# EasyEDA Pro project 3SE_24_Power_Rune.eprj, schematic Armour (continued)
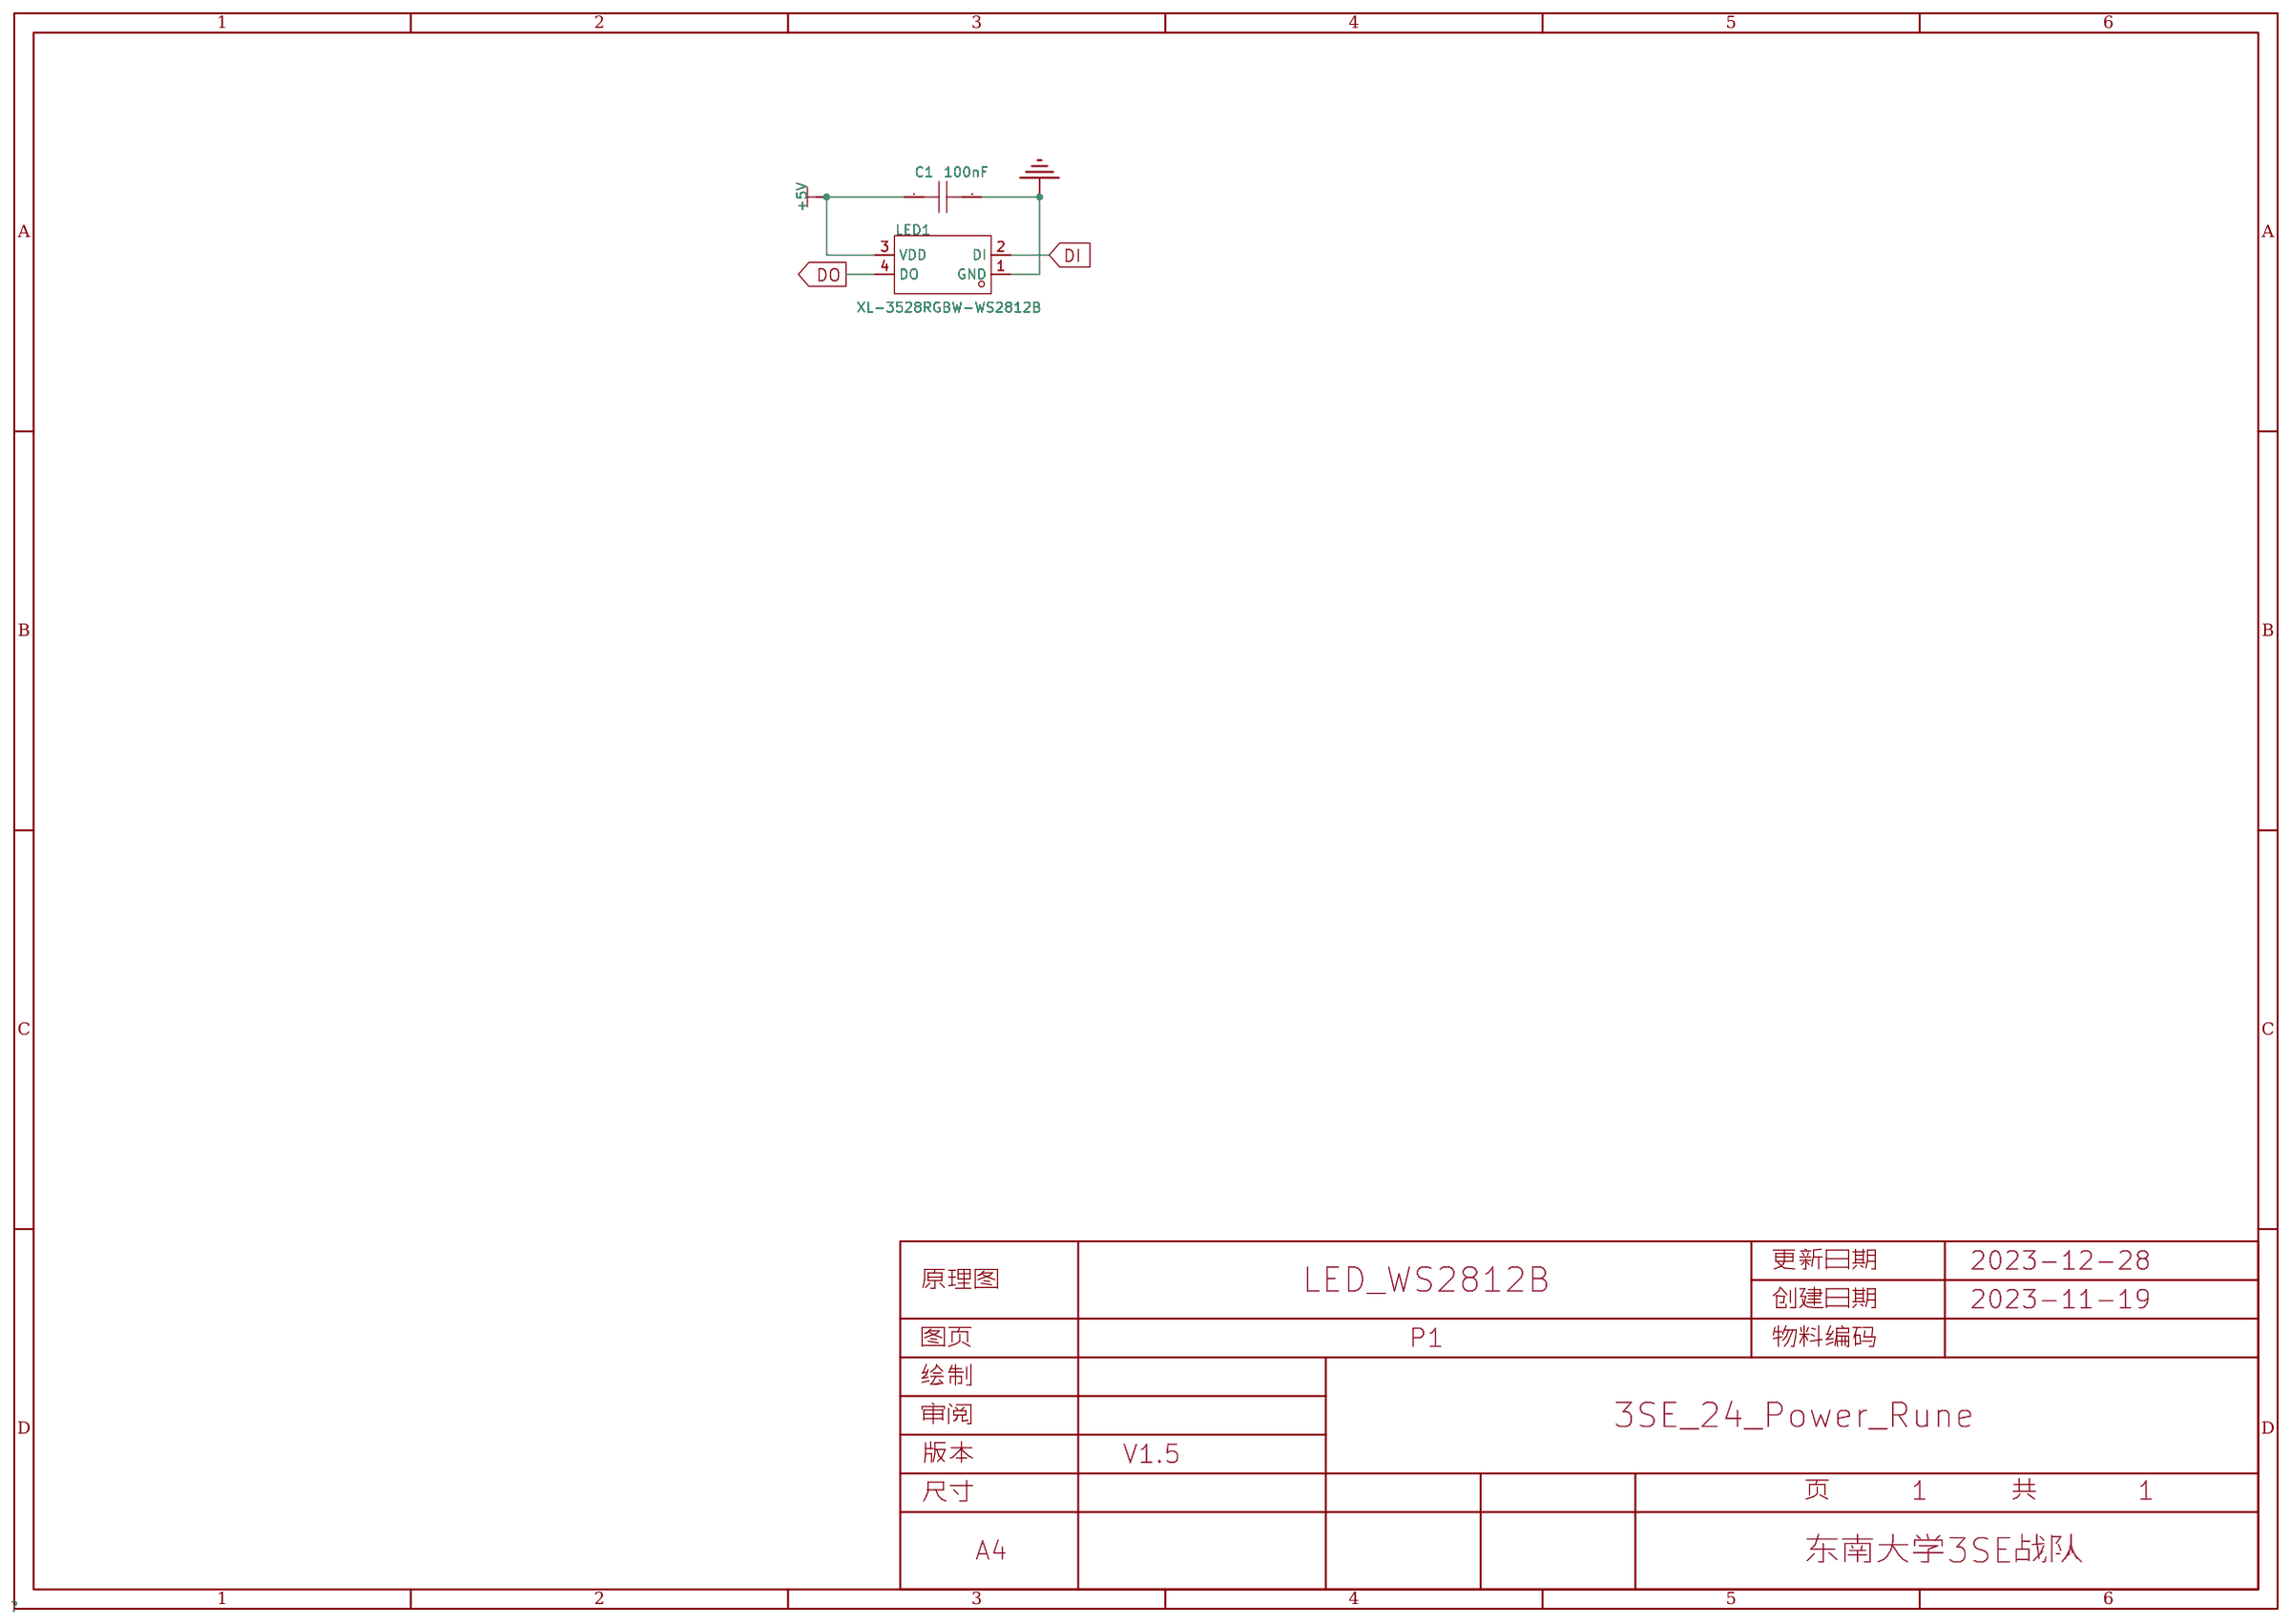
[diagram p0: schematic sheet]
## Library data of the parts (continued)
SW3 = DSHP01TSGER: 电路结构:单刀单掷;开关位数:1位;额定电流:25mA;额定电压:24V;使用寿命:3千次;颜色:黑色;; LCSC Part Name: 1位单PIN 1.27mm间距贴片型 KE拨码开关 编码开关; Supplier Part: C3293141; Manufacturer: 康深; Supplier Footprint: SMD,2.9x5.4mm; JLCPCB Part Class: 扩展库; Datasheet: https://atta.szlcsc.com/upload/public/pdf/source/20220713/BDDC0447A52B6A23E8804DA200FD4C7C.pdf; Supplier: LCSC; Circuit: 单刀单掷; Number of Positions: 1位; Current Rating: 25mA; Voltage Rating: 24V; Operating Temperature: -30℃~+85℃; Operating Life: 3千次; Color: 黑色
U1 = XL4016E1: 功能类型:降压型;输入电压:8V~40V;输出电压:1.25V~36V;输出电流(最大值):8A;; Supplier Part: C55881; Manufacturer: XLSEMI(芯龙); Supplier Footprint: TO-220-5; JLCPCB Part Class: 扩展库; Datasheet: https://atta.szlcsc.com/upload/public/pdf/source/20221017/BA256A5392B705775B4C335FAFB3EDCF.pdf; Supplier: LCSC; Function: 降压型; Synchronous Rectification: 否; Number of Outputs: 1; Topology: 降压式; Input Voltage: 8V~40V; Output Voltage: 1.25V~36V; Output Current (Max): 8A; Switching Frequency: 180kHz
U2 = AMS1117-3.3_C347222: 输出类型:固定;最大输入电压:18V;输出电压:3.3V;输出电流:1A;电源纹波抑制比(PSRR):60dB@(120Hz);输出极性:正;; LCSC Part Name: 输入18V 输出3.3V 1A; Supplier Part: C347222; Manufacturer: UMW(友台半导体); Supplier Footprint: SOT-223; JLCPCB Part Class: Extended Part; Datasheet: https://atta.szlcsc.com/upload/public/pdf/source/20231109/155D79A26D9DB04352555A58D5969DC8.pdf; Supplier: LCSC; Output Type: 固定; Output Polarity: 正; Number of Outputs: 1; Maximum Input Voltage: 18V; Output Voltage: 3.3V; Dropout Voltage: 1.3V@(1A); Output Current: 1A; Power Supply Rejection Ratio (PSRR): 60dB@(120Hz)
U3 = ESP32-S3-WROOM-1-N8R2: Supplier Part: C2913204; Manufacturer: ESPRESSIF(乐鑫); Supplier Footprint: SMD,18x25.5mm; JLCPCB Part Class: 扩展库; Datasheet: https://atta.szlcsc.com/upload/public/pdf/source/20220628/A2AC12B3C87735CAEB7EBE2DBE80936C.pdf; Supplier: LCSC
U4 = 74HC4051D,653: Supplier Part: C9386; Manufacturer: Nexperia(安世); Supplier Footprint: SOIC-16; JLCPCB Part Class: 扩展库; Datasheet: https://atta.szlcsc.com/upload/public/pdf/source/20211209/7A90BCDB54D2694B8637C473CF20976E.pdf; Supplier: LCSC
USB1 = TYPE-C 16PIN 2MD(073): 连接器类型:Type-C;标准:-;公母:母座;触点数量:16;端口数量:1;安装方式:卧贴;额定电流 - 电源:5A;工作温度范围:-25℃~+85℃;; LCSC Part Name: TYPE-C母座 16P 4脚插件带定位柱 不锈钢外壳 2次模顶; Supplier Part: C2765186; Manufacturer: SHOU HAN(首韩); Supplier Footprint: SMD; JLCPCB Part Class: 扩展库; Supplier: LCSC; Connector Type: Type-C; Gender: 母座; Number of Contacts: 16; Number of Ports: 1; Mounting Style: 卧贴; Current Rating - Power (Max): 5A; Operating Temperature Range: -25℃~+85℃
X1 = Q13FC1350000400: 频率:32.768kHz;频率公差:±20ppm;负载电容:12.5pF;; LCSC Part Name: 32.768kHz ±20ppm 12.5pF; Supplier Part: C32346; Manufacturer: EPSON(爱普生); Supplier Footprint: SMD3215-2P; JLCPCB Part Class: Basic Part; Datasheet: https://atta.szlcsc.com/upload/public/pdf/source/20190108/C32346_746D6B07EAF90824457A96480007685F.pdf; Supplier: LCSC; Crystal Type: 贴片无源晶振; Frequency Tolerance: ±20ppm; Load Capacitance: 12.5pF; Equivalent Series Resistance (ESR): 70kΩ; Operating Temperature: -40℃~+85℃
KEY1-KEY51 = 热插拔轴座: Check: false

## Nets
+3V3: 3V3.1 C434.1 C435.2 C445.1 C446.1 C448.1 R2.2 R3.2 R5.2 R8.2 R11.2 R12.2 R14.2 R17.2 R18.1 R25.2 R26.2 R28.1 R30.2 R31.1 U2.2(VOUT(TAB)) U2.4(TAB) U3.2(3V3) U4.16(VCC)
+5V: 5V.1 C436.1 C437.2 C438.2 C439.1 C440.2 CN2.1 CN3.1 CN5.1 CN6.4 D3.2(A) D4.5 L1.2 R1.2 U2.3(VIN) USB1.2(VBUS) USB1.11(VBUS)
+24V: 24V.1 C431.2 C432.1 C433.2 CN1.2 D1.2 U1.5(VIN)
GND: C431.1 C432.2 C434.2 C435.1 C436.2 C437.1 C439.2 C440.1 C441.1 C442.1 C443.1 C444.1 C445.2 C446.2 C447.1 C448.2 C449.1 C450.2 C451.1 C452.2 C453.1 C454.2 C456.1 C457.1 CN1.1 CN1.3 CN1.4 CN2.2 CN2.4 CN2.5 CN3.2 CN3.4 CN3.5 CN4.1 CN4.3 CN4.4 CN5.2 CN5.3 CN5.4 CN6.3 CN6.5 CN6.6 D1.1 D2.1(A) D2.3(A) D3.1(K) D4.2 KEY1.1(Pin1) KEY2.1(Pin1) KEY3.1(Pin1) KEY4.1(Pin1) KEY5.1(Pin1) KEY6.1(Pin1) KEY7.1(Pin1) KEY8.1(Pin1) KEY9.1(Pin1) KEY10.1(Pin1) KEY11.1(Pin1) KEY12.1(Pin1) KEY13.1(Pin1) KEY14.1(Pin1) KEY15.1(Pin1) KEY16.1(Pin1) KEY17.1(Pin1) KEY18.1(Pin1) KEY19.1(Pin1) KEY20.1(Pin1) KEY21.1(Pin1) KEY22.1(Pin1) KEY23.1(Pin1) KEY24.1(Pin1) KEY25.1(Pin1) KEY26.1(Pin1) KEY27.1(Pin1) KEY28.1(Pin1) KEY29.1(Pin1) KEY30.1(Pin1) KEY31.1(Pin1) KEY32.1(Pin1) KEY33.1(Pin1) KEY34.1(Pin1) KEY35.1(Pin1) KEY36.1(Pin1) KEY37.1(Pin1) KEY38.1(Pin1) KEY39.1(Pin1) KEY40.1(Pin1) KEY41.1(Pin1) KEY42.1(Pin1) KEY43.1(Pin1) KEY44.1(Pin1) KEY45.1(Pin1) KEY46.1(Pin1) KEY47.1(Pin1) KEY48.1(Pin1) KEY49.1(Pin1) KEY50.1(Pin1) KEY51.1(Pin1) R6.1 R15.1 R20.1 R22.1 R23.1 R24.1 R32.1 R33.1 SW1.2 SW2.2 U1.1(GND) U2.1(ADJ(GND)) U3.1(GND) U3.40(GND) U3.41(GND) U4.7(VEE) U4.8(GND) USB1.1(GND) USB1.12(GND) USB1.13(SHELL) USB1.14(SHELL)
BOOT: SW2.1 U3.27(IO0)
DIN: U3.19(IO11) U4.3(Z)
DIN0: CBB1.1(DI) R23.2 U4.13(Y0)
DIN1: CBB259.1(DI) R22.2 U4.14(Y1)
DIN2: CBB345.1(DI) R20.2 U4.15(Y2)
DIN3: CN2.3 R24.2 U4.12(Y3)
DIN4: CN4.2 R15.2 U4.1(Y4)
DN: D4.6 U3.13(IO19)
DP: D4.4 U3.14(IO20)
KEY1: KEY44.2(Pin2) KEY45.2(Pin2) KEY46.2(Pin2) KEY47.2(Pin2) KEY48.2(Pin2) KEY49.2(Pin2) KEY50.2(Pin2) KEY51.2(Pin2) R4.1
KEY1_IN: C441.2 R2.1 R4.2 U3.39(IO1)
KEY2: KEY36.2(Pin2) KEY37.2(Pin2) KEY38.2(Pin2) KEY39.2(Pin2) KEY40.2(Pin2) KEY41.2(Pin2) KEY42.2(Pin2) KEY43.2(Pin2) R7.1
KEY2_IN: C442.2 R3.1 R7.2 U3.38(IO2)
KEY3: KEY28.2(Pin2) KEY29.2(Pin2) KEY30.2(Pin2) KEY31.2(Pin2) KEY32.2(Pin2) KEY33.2(Pin2) KEY34.2(Pin2) KEY35.2(Pin2) R9.1
KEY3_IN: C443.2 R5.1 R9.2 U3.4(IO4)
KEY4: KEY20.2(Pin2) KEY21.2(Pin2) KEY22.2(Pin2) KEY23.2(Pin2) KEY24.2(Pin2) KEY25.2(Pin2) KEY26.2(Pin2) KEY27.2(Pin2) R10.1
KEY4_IN: C444.2 R8.1 R10.2 U3.5(IO5)
KEY5: KEY16.2(Pin2) KEY17.2(Pin2) KEY18.2(Pin2) KEY19.2(Pin2) R13.1
KEY5_IN: C447.2 R11.1 R13.2 U3.6(IO6)
KEY6: KEY12.2(Pin2) KEY13.2(Pin2) KEY14.2(Pin2) KEY15.2(Pin2) R16.1
KEY6_IN: C449.2 R12.1 R16.2 U3.7(IO7)
KEY7: KEY8.2(Pin2) KEY9.2(Pin2) KEY10.2(Pin2) KEY11.2(Pin2) R19.1
KEY7_IN: C451.2 R14.1 R19.2 U3.18(IO10)
KEY8: KEY4.2(Pin2) KEY5.2(Pin2) KEY6.2(Pin2) KEY7.2(Pin2) R21.1
KEY8_IN: C453.2 R17.1 R21.2 U3.20(IO12)
KEY9: KEY2.2(Pin2) KEY3.2(Pin2) R27.1
KEY9_IN: C456.2 R25.1 R27.2 U3.12(IO8)
KEY10: KEY1.2(Pin2) R29.1
KEY10_IN: C457.2 R26.1 R29.2 U3.17(IO9)
RST: C450.1 R18.2 SW1.1 U3.3(EN)
RX: CN6.1 U3.36(RXD0)
TX: CN6.2 U3.37(TXD0)
~CS0: U3.22(IO14) U4.11(S0)
~CS1: U3.23(IO21) U4.10(S1)
~CS2: U3.31(IO38) U4.9(S2)
~EN_DEMUX: R31.2 SW3.1 U4.6(E)
$11N923: R28.2 U3.15(IO3)
$11N2441: C438.1 R1.1 R6.2 U1.2(FB)
$11N5632: C452.1 U3.8(IO15) X1.1
$11N5639: C454.1 U3.9(IO16) X1.2
$11N5674: SW3.2 U3.21(IO13)
$11N5844: LED431.2(A) R30.1
$11N5848: LED431.1(K) U3.25(IO48)
$11N11553: R32.2 USB1.4(CC1)
$11N11554: R33.2 USB1.10(CC2)
$11N31259: D2.2(K) L1.1 U1.3(SW)
$11N48563: C433.1 U1.4(VC)
$11N53990: D4.3 USB1.6(DP1) USB1.8(DP2)
$11N54016: D4.1 USB1.5(DN2) USB1.7(DN1)
Net-(CBB1-2): CBB1.2(DO) CBB2.1(DI)
Net-(CBB2-2): CBB2.2(DO) CBB3.1(DI)
Net-(CBB3-2): CBB3.2(DO) CBB4.1(DI)
Net-(CBB4-2): CBB4.2(DO) CBB5.1(DI)
Net-(CBB5-2): CBB5.2(DO) CBB6.1(DI)
Net-(CBB6-2): CBB6.2(DO) CBB7.1(DI)
Net-(CBB7-2): CBB7.2(DO) CBB8.1(DI)
Net-(CBB8-2): CBB8.2(DO) CBB9.1(DI)
Net-(CBB9-2): CBB9.2(DO) CBB10.1(DI)
Net-(CBB10-2): CBB10.2(DO) CBB11.1(DI)
Net-(CBB11-2): CBB11.2(DO) CBB12.1(DI)
Net-(CBB12-2): CBB12.2(DO) CBB13.1(DI)
Net-(CBB13-2): CBB13.2(DO) CBB14.1(DI)
Net-(CBB14-2): CBB14.2(DO) CBB15.1(DI)
Net-(CBB15-2): CBB15.2(DO) CBB16.1(DI)
Net-(CBB16-2): CBB16.2(DO) CBB17.1(DI)
Net-(CBB17-2): CBB17.2(DO) CBB18.1(DI)
Net-(CBB18-2): CBB18.2(DO) CBB19.1(DI)
Net-(CBB19-2): CBB19.2(DO) CBB20.1(DI)
Net-(CBB20-2): CBB20.2(DO) CBB21.1(DI)
Net-(CBB21-2): CBB21.2(DO) CBB22.1(DI)
Net-(CBB22-2): CBB22.2(DO) CBB23.1(DI)
Net-(CBB23-2): CBB23.2(DO) CBB24.1(DI)
Net-(CBB24-2): CBB24.2(DO) CBB25.1(DI)
Net-(CBB25-2): CBB25.2(DO) CBB26.1(DI)
Net-(CBB26-2): CBB26.2(DO) CBB27.1(DI)
Net-(CBB27-2): CBB27.2(DO) CBB28.1(DI)
Net-(CBB28-2): CBB28.2(DO) CBB29.1(DI)
Net-(CBB29-2): CBB29.2(DO) CBB30.1(DI)
Net-(CBB30-2): CBB30.2(DO) CBB31.1(DI)
Net-(CBB31-2): CBB31.2(DO) CBB32.1(DI)
Net-(CBB32-2): CBB32.2(DO) CBB33.1(DI)
Net-(CBB33-2): CBB33.2(DO) CBB34.1(DI)
Net-(CBB34-2): CBB34.2(DO) CBB35.1(DI)
Net-(CBB35-2): CBB35.2(DO) CBB36.1(DI)
Net-(CBB36-2): CBB36.2(DO) CBB37.1(DI)
Net-(CBB37-2): CBB37.2(DO) CBB38.1(DI)
Net-(CBB38-2): CBB38.2(DO) CBB39.1(DI)
Net-(CBB39-2): CBB39.2(DO) CBB40.1(DI)
Net-(CBB40-2): CBB40.2(DO) CBB41.1(DI)
Net-(CBB41-2): CBB41.2(DO) CBB42.1(DI)
Net-(CBB42-2): CBB42.2(DO) CBB43.1(DI)
Net-(CBB43-2): CBB43.2(DO) CBB44.1(DI)
Net-(CBB44-2): CBB44.2(DO) CBB45.1(DI)
Net-(CBB45-2): CBB45.2(DO) CBB46.1(DI)
Net-(CBB46-2): CBB46.2(DO) CBB47.1(DI)
Net-(CBB47-2): CBB47.2(DO) CBB48.1(DI)
Net-(CBB48-2): CBB48.2(DO) CBB49.1(DI)
Net-(CBB49-2): CBB49.2(DO) CBB50.1(DI)
Net-(CBB50-2): CBB50.2(DO) CBB51.1(DI)
Net-(CBB51-2): CBB51.2(DO) CBB52.1(DI)
Net-(CBB52-2): CBB52.2(DO) CBB53.1(DI)
Net-(CBB53-2): CBB53.2(DO) CBB54.1(DI)
Net-(CBB54-2): CBB54.2(DO) CBB55.1(DI)
Net-(CBB55-2): CBB55.2(DO) CBB56.1(DI)
Net-(CBB56-2): CBB56.2(DO) CBB57.1(DI)
Net-(CBB57-2): CBB57.2(DO) CBB58.1(DI)
Net-(CBB58-2): CBB58.2(DO) CBB59.1(DI)
Net-(CBB59-2): CBB59.2(DO) CBB60.1(DI)
Net-(CBB60-2): CBB60.2(DO) CBB61.1(DI)
Net-(CBB61-2): CBB61.2(DO) CBB62.1(DI)
Net-(CBB62-2): CBB62.2(DO) CBB63.1(DI)
Net-(CBB63-2): CBB63.2(DO) CBB64.1(DI)
Net-(CBB64-2): CBB64.2(DO) CBB65.1(DI)
Net-(CBB65-2): CBB65.2(DO) CBB66.1(DI)
Net-(CBB66-2): CBB66.2(DO) CBB67.1(DI)
Net-(CBB67-2): CBB67.2(DO) CBB68.1(DI)
Net-(CBB68-2): CBB68.2(DO) CBB69.1(DI)
Net-(CBB69-2): CBB69.2(DO) CBB70.1(DI)
Net-(CBB70-2): CBB70.2(DO) CBB71.1(DI)
Net-(CBB71-2): CBB71.2(DO) CBB72.1(DI)
Net-(CBB72-2): CBB72.2(DO) CBB73.1(DI)
Net-(CBB73-2): CBB73.2(DO) CBB74.1(DI)
Net-(CBB74-2): CBB74.2(DO) CBB75.1(DI)
Net-(CBB75-2): CBB75.2(DO) CBB76.1(DI)
Net-(CBB76-2): CBB76.2(DO) CBB77.1(DI)
Net-(CBB77-2): CBB77.2(DO) CBB78.1(DI)
Net-(CBB78-2): CBB78.2(DO) CBB79.1(DI)
Net-(CBB79-2): CBB79.2(DO) CBB80.1(DI)
Net-(CBB80-2): CBB80.2(DO) CBB81.1(DI)
Net-(CBB81-2): CBB81.2(DO) CBB82.1(DI)
Net-(CBB82-2): CBB82.2(DO) CBB83.1(DI)
Net-(CBB83-2): CBB83.2(DO) CBB84.1(DI)
Net-(CBB84-2): CBB84.2(DO) CBB85.1(DI)
Net-(CBB85-2): CBB85.2(DO) CBB86.1(DI)
Net-(CBB86-2): CBB86.2(DO) CBB87.1(DI)
Net-(CBB87-2): CBB87.2(DO) CBB88.1(DI)
Net-(CBB88-2): CBB88.2(DO) CBB89.1(DI)
Net-(CBB89-2): CBB89.2(DO) CBB90.1(DI)
Net-(CBB90-2): CBB90.2(DO) CBB91.1(DI)
Net-(CBB91-2): CBB91.2(DO) CBB92.1(DI)
Net-(CBB92-2): CBB92.2(DO) CBB93.1(DI)
Net-(CBB93-2): CBB93.2(DO) CBB94.1(DI)
Net-(CBB94-2): CBB94.2(DO) CBB95.1(DI)
Net-(CBB95-2): CBB95.2(DO) CBB96.1(DI)
Net-(CBB96-2): CBB96.2(DO) CBB97.1(DI)
Net-(CBB97-2): CBB97.2(DO) CBB98.1(DI)
Net-(CBB98-2): CBB98.2(DO) CBB99.1(DI)
Net-(CBB99-2): CBB99.2(DO) CBB100.1(DI)
Net-(CBB100-2): CBB100.2(DO) CBB101.1(DI)
Net-(CBB101-2): CBB101.2(DO) CBB102.1(DI)
Net-(CBB102-2): CBB102.2(DO) CBB103.1(DI)
Net-(CBB103-2): CBB103.2(DO) CBB104.1(DI)
Net-(CBB104-2): CBB104.2(DO) CBB105.1(DI)
Net-(CBB105-2): CBB105.2(DO) CBB106.1(DI)
Net-(CBB106-2): CBB106.2(DO) CBB107.1(DI)
Net-(CBB107-2): CBB107.2(DO) CBB108.1(DI)
Net-(CBB108-2): CBB108.2(DO) CBB109.1(DI)
Net-(CBB109-2): CBB109.2(DO) CBB110.1(DI)
Net-(CBB110-2): CBB110.2(DO) CBB111.1(DI)
Net-(CBB111-2): CBB111.2(DO) CBB112.1(DI)
Net-(CBB112-2): CBB112.2(DO) CBB113.1(DI)
Net-(CBB113-2): CBB113.2(DO) CBB114.1(DI)
Net-(CBB114-2): CBB114.2(DO) CBB115.1(DI)
Net-(CBB115-2): CBB115.2(DO) CBB116.1(DI)
Net-(CBB116-2): CBB116.2(DO) CBB117.1(DI)
Net-(CBB117-2): CBB117.2(DO) CBB118.1(DI)
Net-(CBB118-2): CBB118.2(DO) CBB119.1(DI)
Net-(CBB119-2): CBB119.2(DO) CBB120.1(DI)
Net-(CBB120-2): CBB120.2(DO) CBB121.1(DI)
Net-(CBB121-2): CBB121.2(DO) CBB122.1(DI)
Net-(CBB122-2): CBB122.2(DO) CBB123.1(DI)
Net-(CBB123-2): CBB123.2(DO) CBB124.1(DI)
Net-(CBB124-2): CBB124.2(DO) CBB125.1(DI)
Net-(CBB125-2): CBB125.2(DO) CBB126.1(DI)
Net-(CBB126-2): CBB126.2(DO) CBB127.1(DI)
Net-(CBB127-2): CBB127.2(DO) CBB128.1(DI)
Net-(CBB128-2): CBB128.2(DO) CBB129.1(DI)
Net-(CBB129-2): CBB129.2(DO) CBB130.1(DI)
Net-(CBB130-2): CBB130.2(DO) CBB131.1(DI)
Net-(CBB131-2): CBB131.2(DO) CBB132.1(DI)
Net-(CBB132-2): CBB132.2(DO) CBB133.1(DI)
Net-(CBB133-2): CBB133.2(DO) CBB134.1(DI)
Net-(CBB134-2): CBB134.2(DO) CBB135.1(DI)
Net-(CBB135-2): CBB135.2(DO) CBB136.1(DI)
Net-(CBB136-2): CBB136.2(DO) CBB137.1(DI)
Net-(CBB137-2): CBB137.2(DO) CBB138.1(DI)
Net-(CBB138-2): CBB138.2(DO) CBB139.1(DI)
Net-(CBB139-2): CBB139.2(DO) CBB140.1(DI)
Net-(CBB140-2): CBB140.2(DO) CBB141.1(DI)
Net-(CBB141-2): CBB141.2(DO) CBB142.1(DI)
Net-(CBB142-2): CBB142.2(DO) CBB143.1(DI)
Net-(CBB143-2): CBB143.2(DO) CBB144.1(DI)
Net-(CBB144-2): CBB144.2(DO) CBB145.1(DI)
Net-(CBB145-2): CBB145.2(DO) CBB146.1(DI)
Net-(CBB146-2): CBB146.2(DO) CBB147.1(DI)
Net-(CBB147-2): CBB147.2(DO) CBB148.1(DI)
Net-(CBB148-2): CBB148.2(DO) CBB149.1(DI)
Net-(CBB149-2): CBB149.2(DO) CBB150.1(DI)
Net-(CBB150-2): CBB150.2(DO) CBB151.1(DI)
Net-(CBB151-2): CBB151.2(DO) CBB152.1(DI)
Net-(CBB152-2): CBB152.2(DO) CBB153.1(DI)
Net-(CBB153-2): CBB153.2(DO) CBB154.1(DI)
Net-(CBB154-2): CBB154.2(DO) CBB155.1(DI)
Net-(CBB155-2): CBB155.2(DO) CBB156.1(DI)
Net-(CBB156-2): CBB156.2(DO) CBB157.1(DI)
Net-(CBB157-2): CBB157.2(DO) CBB158.1(DI)
Net-(CBB158-2): CBB158.2(DO) CBB159.1(DI)
Net-(CBB159-2): CBB159.2(DO) CBB160.1(DI)
Net-(CBB160-2): CBB160.2(DO) CBB161.1(DI)
Net-(CBB161-2): CBB161.2(DO) CBB162.1(DI)
Net-(CBB162-2): CBB162.2(DO) CBB163.1(DI)
Net-(CBB163-2): CBB163.2(DO) CBB164.1(DI)
Net-(CBB164-2): CBB164.2(DO) CBB165.1(DI)
Net-(CBB165-2): CBB165.2(DO) CBB166.1(DI)
Net-(CBB166-2): CBB166.2(DO) CBB167.1(DI)
Net-(CBB167-2): CBB167.2(DO) CBB168.1(DI)
Net-(CBB168-2): CBB168.2(DO) CBB169.1(DI)
Net-(CBB169-2): CBB169.2(DO) CBB170.1(DI)
Net-(CBB170-2): CBB170.2(DO) CBB171.1(DI)
Net-(CBB171-2): CBB171.2(DO) CBB172.1(DI)
Net-(CBB172-2): CBB172.2(DO) CBB173.1(DI)
Net-(CBB173-2): CBB173.2(DO) CBB174.1(DI)
Net-(CBB174-2): CBB174.2(DO) CBB175.1(DI)
Net-(CBB175-2): CBB175.2(DO) CBB176.1(DI)
Net-(CBB176-2): CBB176.2(DO) CBB177.1(DI)
Net-(CBB177-2): CBB177.2(DO) CBB178.1(DI)
Net-(CBB178-2): CBB178.2(DO) CBB179.1(DI)
Net-(CBB179-2): CBB179.2(DO) CBB180.1(DI)
Net-(CBB180-2): CBB180.2(DO) CBB181.1(DI)
Net-(CBB181-2): CBB181.2(DO) CBB182.1(DI)
Net-(CBB182-2): CBB182.2(DO) CBB183.1(DI)
Net-(CBB183-2): CBB183.2(DO) CBB184.1(DI)
Net-(CBB184-2): CBB184.2(DO) CBB185.1(DI)
Net-(CBB185-2): CBB185.2(DO) CBB186.1(DI)
Net-(CBB186-2): CBB186.2(DO) CBB187.1(DI)
Net-(CBB187-2): CBB187.2(DO) CBB188.1(DI)
Net-(CBB188-2): CBB188.2(DO) CBB189.1(DI)
Net-(CBB189-2): CBB189.2(DO) CBB190.1(DI)
Net-(CBB190-2): CBB190.2(DO) CBB191.1(DI)
Net-(CBB191-2): CBB191.2(DO) CBB192.1(DI)
Net-(CBB192-2): CBB192.2(DO) CBB193.1(DI)
Net-(CBB193-2): CBB193.2(DO) CBB194.1(DI)
Net-(CBB194-2): CBB194.2(DO) CBB195.1(DI)
Net-(CBB195-2): CBB195.2(DO) CBB196.1(DI)
Net-(CBB196-2): CBB196.2(DO) CBB197.1(DI)
Net-(CBB197-2): CBB197.2(DO) CBB198.1(DI)
Net-(CBB198-2): CBB198.2(DO) CBB199.1(DI)
Net-(CBB199-2): CBB199.2(DO) CBB200.1(DI)
Net-(CBB200-2): CBB200.2(DO) CBB201.1(DI)
Net-(CBB201-2): CBB201.2(DO) CBB202.1(DI)
Net-(CBB202-2): CBB202.2(DO) CBB203.1(DI)
Net-(CBB203-2): CBB203.2(DO) CBB204.1(DI)
Net-(CBB204-2): CBB204.2(DO) CBB205.1(DI)
Net-(CBB205-2): CBB205.2(DO) CBB206.1(DI)
Net-(CBB206-2): CBB206.2(DO) CBB207.1(DI)
Net-(CBB207-2): CBB207.2(DO) CBB208.1(DI)
Net-(CBB208-2): CBB208.2(DO) CBB209.1(DI)
Net-(CBB209-2): CBB209.2(DO) CBB210.1(DI)
Net-(CBB210-2): CBB210.2(DO) CBB211.1(DI)
Net-(CBB211-2): CBB211.2(DO) CBB212.1(DI)
Net-(CBB212-2): CBB212.2(DO) CBB213.1(DI)
Net-(CBB213-2): CBB213.2(DO) CBB214.1(DI)
Net-(CBB214-2): CBB214.2(DO) CBB215.1(DI)
Net-(CBB215-2): CBB215.2(DO) CBB216.1(DI)
Net-(CBB216-2): CBB216.2(DO) CBB217.1(DI)
Net-(CBB217-2): CBB217.2(DO) CBB218.1(DI)
Net-(CBB218-2): CBB218.2(DO) CBB219.1(DI)
Net-(CBB219-2): CBB219.2(DO) CBB220.1(DI)
Net-(CBB220-2): CBB220.2(DO) CBB221.1(DI)
Net-(CBB221-2): CBB221.2(DO) CBB222.1(DI)
Net-(CBB222-2): CBB222.2(DO) CBB223.1(DI)
Net-(CBB223-2): CBB223.2(DO) CBB224.1(DI)
Net-(CBB224-2): CBB224.2(DO) CBB225.1(DI)
Net-(CBB225-2): CBB225.2(DO) CBB226.1(DI)
Net-(CBB226-2): CBB226.2(DO) CBB227.1(DI)
Net-(CBB227-2): CBB227.2(DO) CBB228.1(DI)
Net-(CBB228-2): CBB228.2(DO) CBB229.1(DI)
Net-(CBB229-2): CBB229.2(DO) CBB230.1(DI)
Net-(CBB230-2): CBB230.2(DO) CBB231.1(DI)
Net-(CBB231-2): CBB231.2(DO) CBB232.1(DI)
Net-(CBB232-2): CBB232.2(DO) CBB233.1(DI)
Net-(CBB233-2): CBB233.2(DO) CBB234.1(DI)
Net-(CBB234-2): CBB234.2(DO) CBB235.1(DI)
Net-(CBB235-2): CBB235.2(DO) CBB236.1(DI)
Net-(CBB236-2): CBB236.2(DO) CBB237.1(DI)
Net-(CBB237-2): CBB237.2(DO) CBB238.1(DI)
Net-(CBB238-2): CBB238.2(DO) CBB239.1(DI)
Net-(CBB239-2): CBB239.2(DO) CBB240.1(DI)
Net-(CBB240-2): CBB240.2(DO) CBB241.1(DI)
Net-(CBB241-2): CBB241.2(DO) CBB242.1(DI)
Net-(CBB242-2): CBB242.2(DO) CBB243.1(DI)
Net-(CBB243-2): CBB243.2(DO) CBB244.1(DI)
Net-(CBB244-2): CBB244.2(DO) CBB245.1(DI)
Net-(CBB245-2): CBB245.2(DO) CBB246.1(DI)
Net-(CBB246-2): CBB246.2(DO) CBB247.1(DI)
Net-(CBB247-2): CBB247.2(DO) CBB248.1(DI)
Net-(CBB248-2): CBB248.2(DO) CBB249.1(DI)
Net-(CBB249-2): CBB249.2(DO) CBB250.1(DI)
Net-(CBB250-2): CBB250.2(DO) CBB251.1(DI)
Net-(CBB251-2): CBB251.2(DO) CBB252.1(DI)
Net-(CBB252-2): CBB252.2(DO) CBB253.1(DI)
Net-(CBB253-2): CBB253.2(DO) CBB254.1(DI)
Net-(CBB254-2): CBB254.2(DO) CBB255.1(DI)
Net-(CBB255-2): CBB255.2(DO) CBB256.1(DI)
Net-(CBB256-2): CBB256.2(DO) CBB257.1(DI)
Net-(CBB257-2): CBB257.2(DO) CBB258.1(DI)
Net-(CBB259-2): CBB259.2(DO) CBB260.1(DI)
Net-(CBB260-2): CBB260.2(DO) CBB261.1(DI)
Net-(CBB261-2): CBB261.2(DO) CBB262.1(DI)
Net-(CBB262-2): CBB262.2(DO) CBB263.1(DI)
Net-(CBB263-2): CBB263.2(DO) CBB264.1(DI)
Net-(CBB264-2): CBB264.2(DO) CBB265.1(DI)
Net-(CBB265-2): CBB265.2(DO) CBB266.1(DI)
Net-(CBB266-2): CBB266.2(DO) CBB267.1(DI)
Net-(CBB267-2): CBB267.2(DO) CBB268.1(DI)
Net-(CBB268-2): CBB268.2(DO) CBB269.1(DI)
Net-(CBB269-2): CBB269.2(DO) CBB270.1(DI)
Net-(CBB270-2): CBB270.2(DO) CBB271.1(DI)
Net-(CBB271-2): CBB271.2(DO) CBB272.1(DI)
Net-(CBB272-2): CBB272.2(DO) CBB273.1(DI)
Net-(CBB273-2): CBB273.2(DO) CBB274.1(DI)
Net-(CBB274-2): CBB274.2(DO) CBB275.1(DI)
Net-(CBB275-2): CBB275.2(DO) CBB276.1(DI)
Net-(CBB276-2): CBB276.2(DO) CBB277.1(DI)
Net-(CBB277-2): CBB277.2(DO) CBB278.1(DI)
Net-(CBB278-2): CBB278.2(DO) CBB279.1(DI)
Net-(CBB279-2): CBB279.2(DO) CBB280.1(DI)
Net-(CBB280-2): CBB280.2(DO) CBB281.1(DI)
Net-(CBB281-2): CBB281.2(DO) CBB282.1(DI)
Net-(CBB282-2): CBB282.2(DO) CBB283.1(DI)
Net-(CBB283-2): CBB283.2(DO) CBB284.1(DI)
Net-(CBB284-2): CBB284.2(DO) CBB285.1(DI)
Net-(CBB285-2): CBB285.2(DO) CBB286.1(DI)
Net-(CBB286-2): CBB286.2(DO) CBB287.1(DI)
Net-(CBB287-2): CBB287.2(DO) CBB288.1(DI)
Net-(CBB288-2): CBB288.2(DO) CBB289.1(DI)
Net-(CBB289-2): CBB289.2(DO) CBB290.1(DI)
Net-(CBB290-2): CBB290.2(DO) CBB291.1(DI)
Net-(CBB291-2): CBB291.2(DO) CBB292.1(DI)
Net-(CBB292-2): CBB292.2(DO) CBB293.1(DI)
Net-(CBB293-2): CBB293.2(DO) CBB294.1(DI)
Net-(CBB294-2): CBB294.2(DO) CBB295.1(DI)
Net-(CBB295-2): CBB295.2(DO) CBB296.1(DI)
Net-(CBB296-2): CBB296.2(DO) CBB297.1(DI)
Net-(CBB297-2): CBB297.2(DO) CBB298.1(DI)
Net-(CBB298-2): CBB298.2(DO) CBB299.1(DI)
Net-(CBB299-2): CBB299.2(DO) CBB300.1(DI)
Net-(CBB300-2): CBB300.2(DO) CBB301.1(DI)
Net-(CBB301-2): CBB301.2(DO) CBB302.1(DI)
Net-(CBB302-2): CBB302.2(DO) CBB303.1(DI)
Net-(CBB303-2): CBB303.2(DO) CBB304.1(DI)
Net-(CBB304-2): CBB304.2(DO) CBB305.1(DI)
Net-(CBB305-2): CBB305.2(DO) CBB306.1(DI)
Net-(CBB306-2): CBB306.2(DO) CBB307.1(DI)
Net-(CBB307-2): CBB307.2(DO) CBB308.1(DI)
Net-(CBB308-2): CBB308.2(DO) CBB309.1(DI)
Net-(CBB309-2): CBB309.2(DO) CBB310.1(DI)
Net-(CBB310-2): CBB310.2(DO) CBB311.1(DI)
Net-(CBB311-2): CBB311.2(DO) CBB312.1(DI)
Net-(CBB312-2): CBB312.2(DO) CBB313.1(DI)
Net-(CBB313-2): CBB313.2(DO) CBB314.1(DI)
Net-(CBB314-2): CBB314.2(DO) CBB315.1(DI)
Net-(CBB315-2): CBB315.2(DO) CBB316.1(DI)
Net-(CBB316-2): CBB316.2(DO) CBB317.1(DI)
Net-(CBB317-2): CBB317.2(DO) CBB318.1(DI)
Net-(CBB318-2): CBB318.2(DO) CBB319.1(DI)
Net-(CBB319-2): CBB319.2(DO) CBB320.1(DI)
Net-(CBB320-2): CBB320.2(DO) CBB321.1(DI)
Net-(CBB321-2): CBB321.2(DO) CBB322.1(DI)
Net-(CBB322-2): CBB322.2(DO) CBB323.1(DI)
Net-(CBB323-2): CBB323.2(DO) CBB324.1(DI)
Net-(CBB324-2): CBB324.2(DO) CBB325.1(DI)
Net-(CBB325-2): CBB325.2(DO) CBB326.1(DI)
Net-(CBB326-2): CBB326.2(DO) CBB327.1(DI)
Net-(CBB327-2): CBB327.2(DO) CBB328.1(DI)
Net-(CBB328-2): CBB328.2(DO) CBB329.1(DI)
Net-(CBB329-2): CBB329.2(DO) CBB330.1(DI)
Net-(CBB330-2): CBB330.2(DO) CBB331.1(DI)
Net-(CBB331-2): CBB331.2(DO) CBB332.1(DI)
Net-(CBB332-2): CBB332.2(DO) CBB333.1(DI)
Net-(CBB333-2): CBB333.2(DO) CBB334.1(DI)
Net-(CBB334-2): CBB334.2(DO) CBB335.1(DI)
Net-(CBB335-2): CBB335.2(DO) CBB336.1(DI)
Net-(CBB336-2): CBB336.2(DO) CBB337.1(DI)
Net-(CBB337-2): CBB337.2(DO) CBB338.1(DI)
Net-(CBB338-2): CBB338.2(DO) CBB339.1(DI)
Net-(CBB339-2): CBB339.2(DO) CBB340.1(DI)
Net-(CBB340-2): CBB340.2(DO) CBB341.1(DI)
Net-(CBB341-2): CBB341.2(DO) CBB342.1(DI)
Net-(CBB342-2): CBB342.2(DO) CBB343.1(DI)
Net-(CBB343-2): CBB343.2(DO) CBB344.1(DI)
Net-(CBB345-2): CBB345.2(DO) CBB346.1(DI)
Net-(CBB346-2): CBB346.2(DO) CBB347.1(DI)
Net-(CBB347-2): CBB347.2(DO) CBB348.1(DI)
Net-(CBB348-2): CBB348.2(DO) CBB349.1(DI)
Net-(CBB349-2): CBB349.2(DO) CBB350.1(DI)
Net-(CBB350-2): CBB350.2(DO) CBB351.1(DI)
Net-(CBB351-2): CBB351.2(DO) CBB352.1(DI)
Net-(CBB352-2): CBB352.2(DO) CBB353.1(DI)
Net-(CBB353-2): CBB353.2(DO) CBB354.1(DI)
Net-(CBB354-2): CBB354.2(DO) CBB355.1(DI)
Net-(CBB355-2): CBB355.2(DO) CBB356.1(DI)
Net-(CBB356-2): CBB356.2(DO) CBB357.1(DI)
Net-(CBB357-2): CBB357.2(DO) CBB358.1(DI)
Net-(CBB358-2): CBB358.2(DO) CBB359.1(DI)
Net-(CBB359-2): CBB359.2(DO) CBB360.1(DI)
Net-(CBB360-2): CBB360.2(DO) CBB361.1(DI)
Net-(CBB361-2): CBB361.2(DO) CBB362.1(DI)
Net-(CBB362-2): CBB362.2(DO) CBB363.1(DI)
Net-(CBB363-2): CBB363.2(DO) CBB364.1(DI)
Net-(CBB364-2): CBB364.2(DO) CBB365.1(DI)
Net-(CBB365-2): CBB365.2(DO) CBB366.1(DI)
Net-(CBB366-2): CBB366.2(DO) CBB367.1(DI)
Net-(CBB367-2): CBB367.2(DO) CBB368.1(DI)
Net-(CBB368-2): CBB368.2(DO) CBB369.1(DI)
Net-(CBB369-2): CBB369.2(DO) CBB370.1(DI)
Net-(CBB370-2): CBB370.2(DO) CBB371.1(DI)
Net-(CBB371-2): CBB371.2(DO) CBB372.1(DI)
Net-(CBB372-2): CBB372.2(DO) CBB373.1(DI)
Net-(CBB373-2): CBB373.2(DO) CBB374.1(DI)
Net-(CBB374-2): CBB374.2(DO) CBB375.1(DI)
Net-(CBB375-2): CBB375.2(DO) CBB376.1(DI)
Net-(CBB376-2): CBB376.2(DO) CBB377.1(DI)
Net-(CBB377-2): CBB377.2(DO) CBB378.1(DI)
Net-(CBB378-2): CBB378.2(DO) CBB379.1(DI)
Net-(CBB379-2): CBB379.2(DO) CBB380.1(DI)
Net-(CBB380-2): CBB380.2(DO) CBB381.1(DI)
Net-(CBB381-2): CBB381.2(DO) CBB382.1(DI)
Net-(CBB382-2): CBB382.2(DO) CBB383.1(DI)
Net-(CBB383-2): CBB383.2(DO) CBB384.1(DI)
Net-(CBB384-2): CBB384.2(DO) CBB385.1(DI)
Net-(CBB385-2): CBB385.2(DO) CBB386.1(DI)
Net-(CBB386-2): CBB386.2(DO) CBB387.1(DI)
Net-(CBB387-2): CBB387.2(DO) CBB388.1(DI)
Net-(CBB388-2): CBB388.2(DO) CBB389.1(DI)
Net-(CBB389-2): CBB389.2(DO) CBB390.1(DI)
Net-(CBB390-2): CBB390.2(DO) CBB391.1(DI)
Net-(CBB391-2): CBB391.2(DO) CBB392.1(DI)
Net-(CBB392-2): CBB392.2(DO) CBB393.1(DI)
Net-(CBB393-2): CBB393.2(DO) CBB394.1(DI)
Net-(CBB394-2): CBB394.2(DO) CBB395.1(DI)
Net-(CBB395-2): CBB395.2(DO) CBB396.1(DI)
Net-(CBB396-2): CBB396.2(DO) CBB397.1(DI)
Net-(CBB397-2): CBB397.2(DO) CBB398.1(DI)
Net-(CBB398-2): CBB398.2(DO) CBB399.1(DI)
Net-(CBB399-2): CBB399.2(DO) CBB400.1(DI)
Net-(CBB400-2): CBB400.2(DO) CBB401.1(DI)
Net-(CBB401-2): CBB401.2(DO) CBB402.1(DI)
Net-(CBB402-2): CBB402.2(DO) CBB403.1(DI)
Net-(CBB403-2): CBB403.2(DO) CBB404.1(DI)
Net-(CBB404-2): CBB404.2(DO) CBB405.1(DI)
Net-(CBB405-2): CBB405.2(DO) CBB406.1(DI)
Net-(CBB406-2): CBB406.2(DO) CBB407.1(DI)
Net-(CBB407-2): CBB407.2(DO) CBB408.1(DI)
Net-(CBB408-2): CBB408.2(DO) CBB409.1(DI)
Net-(CBB409-2): CBB409.2(DO) CBB410.1(DI)
Net-(CBB410-2): CBB410.2(DO) CBB411.1(DI)
Net-(CBB411-2): CBB411.2(DO) CBB412.1(DI)
Net-(CBB412-2): CBB412.2(DO) CBB413.1(DI)
Net-(CBB413-2): CBB413.2(DO) CBB414.1(DI)
Net-(CBB414-2): CBB414.2(DO) CBB415.1(DI)
Net-(CBB415-2): CBB415.2(DO) CBB416.1(DI)
Net-(CBB416-2): CBB416.2(DO) CBB417.1(DI)
Net-(CBB417-2): CBB417.2(DO) CBB418.1(DI)
Net-(CBB418-2): CBB418.2(DO) CBB419.1(DI)
Net-(CBB419-2): CBB419.2(DO) CBB420.1(DI)
Net-(CBB420-2): CBB420.2(DO) CBB421.1(DI)
Net-(CBB421-2): CBB421.2(DO) CBB422.1(DI)
Net-(CBB422-2): CBB422.2(DO) CBB423.1(DI)
Net-(CBB423-2): CBB423.2(DO) CBB424.1(DI)
Net-(CBB424-2): CBB424.2(DO) CBB425.1(DI)
Net-(CBB425-2): CBB425.2(DO) CBB426.1(DI)
Net-(CBB426-2): CBB426.2(DO) CBB427.1(DI)
Net-(CBB427-2): CBB427.2(DO) CBB428.1(DI)
Net-(CBB428-2): CBB428.2(DO) CBB429.1(DI)
Net-(CBB429-2): CBB429.2(DO) CBB430.1(DI)
Net-(CBB430-2): CBB430.2(DO) CBB431.1(DI)
Net-(CBB431-2): CBB431.2(DO) CBB432.1(DI)
Net-(CBB432-2): CBB432.2(DO) CBB433.1(DI)
Net-(CBB433-2): CBB433.2(DO) CBB434.1(DI)
Net-(CBB434-2): CBB434.2(DO) CBB435.1(DI)
Net-(CBB435-2): CBB435.2(DO) CBB436.1(DI)

Not connected (* = marked no-connect by the designer): CBB258 2(DO)*; CBB344 2(DO)*; CBB436 2(DO)*; CN3 3; U3 10(IO17)* 11(IO18)* 16(IO46)* 24(IO47)* 26(IO45)* 28(IO35)* 29(IO36)* 30(IO37)* 32(IO39)* 33(IO40)* 34(IO41)* 35(IO42)*; U4 2(Y6)* 4(Y7)* 5(Y5)*; USB1 3(SBU2)* 9(SBU1)*

## Notes on the sheets
sheet 1
- WS2812B 3528
  功率典型值：5V@12mA => 60mW
  总功率1.44W 电流0.288A
- 十环灯DIN 4+8+12+24+24+24+36+36+40+45+48=301
sheet 3
- 板外灯条
- 十环灯 4+8+12+24+24+24+36+36+40+45+48=301
- 点阵 55*3=165灯
- 周围灯效 172灯
- 5V@0.72A
- 5V@0.72A
- 大符臂灯效 60灯
- 24V@2A
- 5V@0A(不载流)
- 5V@2A
- 总功率 45W 24V@2A
- 灯臂
- 灯臂
- 点阵
- 点阵
- 24V@2A -> 5V@8A
- 硬件消抖矩阵
- 5V -> 3.3V
- 问题：防浪涌保护欠佳
  TVS建议选型 24V: C5295707 5V&USB DNDP：C113977
- 预留接口 该晶振也可以去除
- Strapping:
  • GPIO0 -> BOOT
  • GPIO45 - 0
  • GPIO46 - 0
  • GPIO3 - JTAG
- MCU
- 选通，可以硬件取消LED，也可以软件取消
- 烧录
- USB只供烧录，供电有限，烧录时需要接通24V电源或者硬件取消点灯，以防过载欠压
sheet 4
- 上下顶灯DIN2 86*2=172
